# Altium schematic sheet MAZ000176 - Diagrama eléctrico.SchDoc: MAZ000176 - Diagrama eléctrico
size A; ApprovedBy: Christian Ledwidth; CheckedBy: Nahuel Martinez; Author: Santiago Marti; CompanyName: Body Health; DrawnBy: Santiago Marti; Revision: A; SheetNumber: 1; SheetTotal: 2
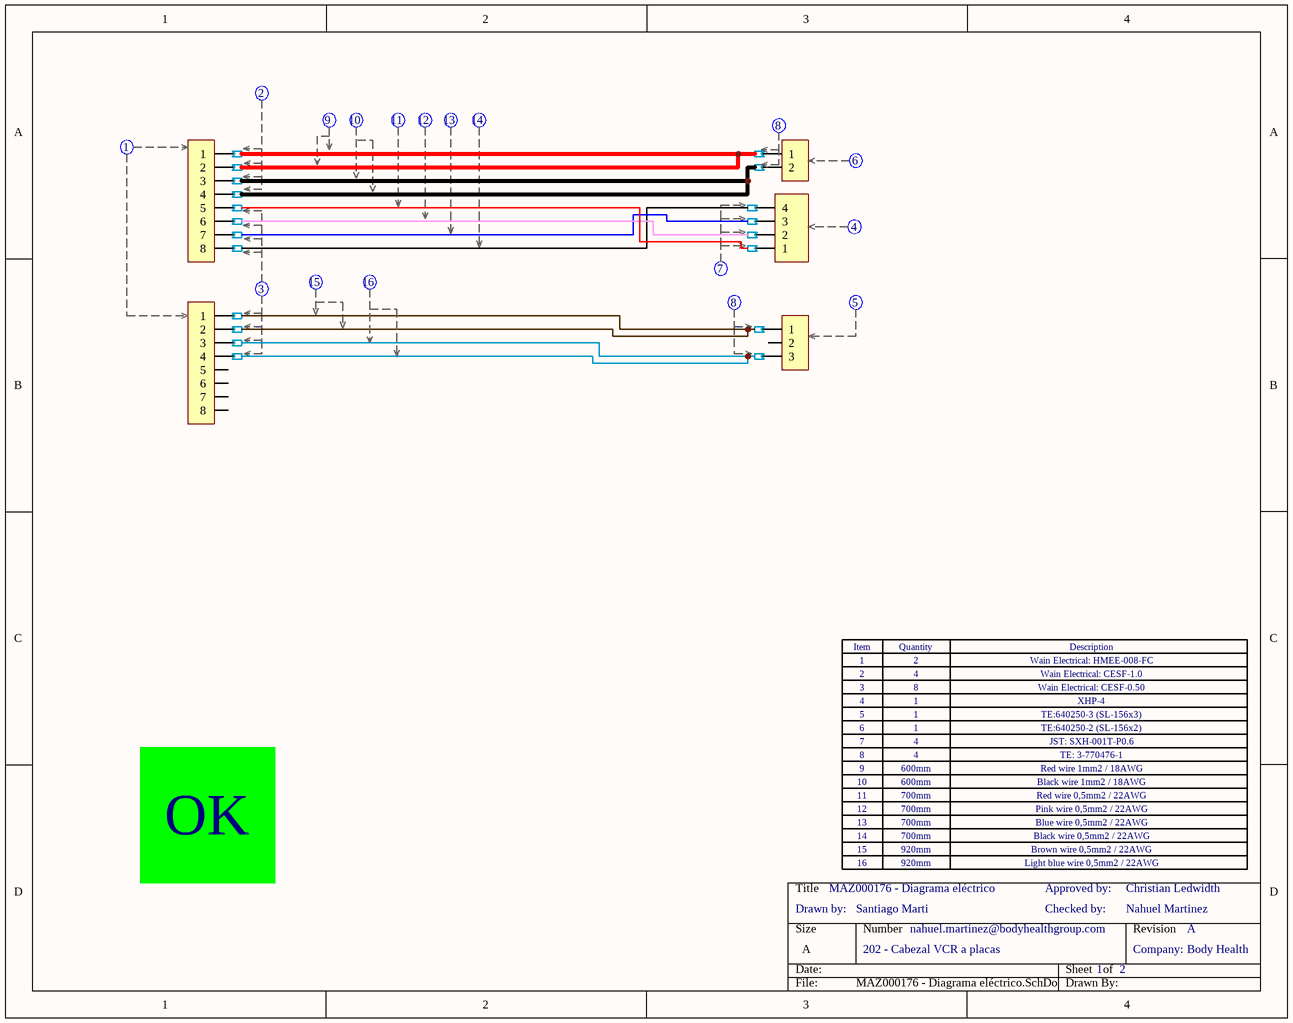
[diagram p0: MAZ000176 - Diagrama eléctrico.SchDoc]

## Parts
(Parts that share a designator on the sheet are numbered #1, #2 ... from top to bottom, then left to right.)
Cab1  Cable  (value not drawn)
Cab2  Cable  (value not drawn)
Cab3  Cable  (value not drawn)
Cab4  Cable  (value not drawn)
Cab5  Cable  (value not drawn)
Cab6  Cable  (value not drawn)
Cab7  Cable  (value not drawn)
Cab?  Cable  (value not drawn)
Con1  SL156-2  (value not drawn)  (parts C,D of 4)
Con2  SL156-3  (value not drawn)  (part C of 4)
Con3  XHP-4  (value not drawn)  (part D of 4)
Con4  09140083101  (value not drawn)  (parts C,D of 4)
Con5  SL156-2  (value not drawn)  (part C of 4)
Con6  09140083101  (value not drawn)  (parts C,D of 4)
Con7  SL156-2  (value not drawn)  (part C of 4)
Con8  SL156-2  (value not drawn)  (part C of 4)
Con?#1  SL156-2  (value not drawn)  (part C of 4)
Con?#2  SL156-3  (value not drawn)  (part C of 4)
Con?#3  SL156-3  (value not drawn)  (part D of 4)
Soc1  sock_XHP_SXH-002T-P0.6  (value not drawn)  (part B of 2)
Soc2  sock_XHP_SXH-002T-P0.6  (value not drawn)  (part B of 2)
Soc3  sock_XHP_SXH-002T-P0.6  (value not drawn)  (part B of 2)
Soc4  sock_XHP_SXH-002T-P0.6  (value not drawn)  (part B of 2)
Soc5  sock_HAR-Female_09330006214  (value not drawn)  (part B of 2)
Soc7  sock_HAR-Female_09330006214  (value not drawn)  (part B of 2)
Soc8  sock_HAR-Female_09330006214  (value not drawn)  (part B of 2)
Soc10  sock_HAR-Female_09330006214  (value not drawn)  (part B of 2)
Soc11  sock_HAR-Female_09330006227  (value not drawn)  (part B of 2)
Soc12  sock_HAR-Female_09330006227  (value not drawn)  (part B of 2)
Soc13  sock_HAR-Female_09330006227  (value not drawn)  (part B of 2)
Soc14  sock_HAR-Female_09330006227  (value not drawn)  (part B of 2)
Soc15  sock_SL156_770476-1  (value not drawn)  (part B of 2)
Soc16  sock_SL156_770476-1  (value not drawn)  (part B of 2)
Soc17  sock_HAR-Female_09330006227  (value not drawn)  (part B of 2)
Soc18  sock_HAR-Female_09330006227  (value not drawn)  (part B of 2)
Soc19  sock_SL156_770476-1  (value not drawn)  (part B of 2)
Soc20  sock_HAR-Female_09330006227  (value not drawn)  (part B of 2)
Soc21  sock_SL156_770476-1  (value not drawn)  (part B of 2)
Soc22  sock_HAR-Female_09330006227  (value not drawn)  (part B of 2)
Zoc1  Zócalo_Header  (value not drawn)
Zoc2  Zócalo_Item  (value not drawn)
Zoc3  Zócalo_Item  (value not drawn)
Zoc4  Zócalo_Item  (value not drawn)
Zoc5  Zócalo_Item  (value not drawn)
Zoc6  Zócalo_Item  (value not drawn)
Zoc7  Zócalo_Item  (value not drawn)
Zoc8  Zócalo_Item  (value not drawn)
Zoc9  Zócalo_Item  (value not drawn)
Zoc10  Zócalo_Item  (value not drawn)
Zoc11#1  Zócalo_Item  (value not drawn)
Zoc11#2  Zócalo_Item  (value not drawn)
Zoc12#1  Zócalo_Item  (value not drawn)
Zoc12#2  Zócalo_Item  (value not drawn)
Zoc13#1  Zócalo_Item  (value not drawn)
Zoc13#2  Zócalo_Item  (value not drawn)
Zoc14  Zócalo_Item  (value not drawn)

## Nets
NetCon1_1: Con1.1 Soc15.0
NetCon1_2: Con1.2 Soc16.0
NetCon3_1: Con3.1 Soc4.0
NetCon3_2: Con3.2 Soc3.0
NetCon3_3: Con3.3 Soc2.0
NetCon3_4: Con3.4 Soc1.0
NetCon4_1: Con4.1 Soc5.0
NetCon4_2: Con4.2 Soc7.0
NetCon4_3: Con4.3 Soc8.0
NetCon4_4: Con4.4 Soc10.0
NetCon4_5: Con4.5 Soc11.0
NetCon4_6: Con4.6 Soc12.0
NetCon4_7: Con4.7 Soc13.0
NetCon4_8: Con4.8 Soc14.0
NetCon6_1: Con6.1 Soc17.0
NetCon6_2: Con6.2 Soc18.0
NetCon6_3: Con6.3 Soc20.0
NetCon6_4: Con6.4 Soc22.0
NetCon?#3_1: Con?#3.1 Soc19.0
NetCon?#3_3: Con?#3.3 Soc21.0
NetSoc1_1: Soc1.1 Soc14.1
NetSoc2_1: Soc2.1 Soc13.1
NetSoc3_1: Soc3.1 Soc12.1
NetSoc4_1: Soc4.1 Soc11.1
NetSoc5_1: Soc5.1 Soc7.1 Soc15.1
NetSoc8_1: Soc8.1 Soc10.1 Soc16.1
NetSoc17_1: Soc17.1 Soc18.1 Soc19.1
NetSoc20_1: Soc20.1 Soc21.1 Soc22.1

Not connected (* = marked no-connect by the designer): Con6 5 6 7 8; Con?#3 2

## Notes on the sheet
- 1
- 2
- 3
- 4
- 8
- Wain Electrical: HMEE-008-FC
- Wain Electrical: CESF-1.0
- Wain Electrical: CESF-0.50
- XHP-4
- 5
- 6
- 7
- 9
- 10
- 600mm
- TE:640250-3 (SL-156x3)
- TE:640250-2 (SL-156x2)
- JST: SXH-001T-P0.6
- TE: 3-770476-1
- Red wire 1mm2 / 18AWG
- Black wire 1mm2 / 18AWG
- OK
- 11
- 12
- 13
- 14
- 700mm
- Red wire 0,5mm2 / 22AWG
- Pink wire 0,5mm2 / 22AWG
- Blue wire 0,5mm2 / 22AWG
- Black wire 0,5mm2 / 22AWG
- Drawn by:
- 15
- 16
- 920mm
- Checked by:
- Approved by:
- Brown wire 0,5mm2 / 22AWG
- Light blue wire 0,5mm2 / 22AWG
- 202 - Cabezal VCR a placas
- nahuel.martinez@bodyhealthgroup.com
- Company:
- (in symbol Zócalo_Header) Item; Quantity; Description

## Library data of the parts
Cab1 = Cable: CallOut: 9; Largo: *mm; Sección: *mm2; Color: *
Cab2 = Cable: CallOut: 10; Largo: *mm; Sección: *mm2; Color: *
Cab3 = Cable: CallOut: 11; Largo: *mm; Sección: *mm2; Color: *
Cab4 = Cable: CallOut: 12; Largo: *mm; Sección: *mm2; Color: *
Cab5 = Cable: CallOut: 13; Largo: *mm; Sección: *mm2; Color: *
Cab6 = Cable: CallOut: 14; Largo: *mm; Sección: *mm2; Color: *
Cab7 = Cable: CallOut: 15; Largo: *mm; Sección: *mm2; Color: *
Cab? = Cable: CallOut: 16; Largo: *mm; Sección: *mm2; Color: *
Con1 = SL156-2: CONN RECEPT 2 POS W/RAMP SL-156; Cod.Fabricante: 640250-2; Fabricante: TE Connectivity AMP Connectors; CallOut: 7; Cod.DigiKey: A19950-ND; ComponentLink1Description: Manufacturer Link; ComponentLink1URL: https://www.te.com/commerce/DocumentDelivery/DDEController?Action=srchrtrv&DocNm=640250&DocType=Customer+Drawing&DocLang=English; DIGIKEYx50: 0.11420; DIGIKEYx100: NO
Con2 = SL156-3: CONN RECEPT 3 POS W/RAMP SL-156; Cod.Fabricante: 640250-3; Fabricante: TE Connectivity AMP Connectors; CallOut: 4; Cod.DigiKey: A19951-ND; ComponentLink1Description: Manufacturer Link; ComponentLink1URL: https://www.te.com/commerce/DocumentDelivery/DDEController?Action=srchrtrv&DocNm=640250&DocType=Customer+Drawing&DocLang=English; DIGIKEYx50: 0.14460; DIGIKEYx100: 0.13430
Con3 = XHP-4: CONN HOUSING 2.5MM 4POS; Fabricante: JST Sales America Inc.; Cod.DigiKey: 455-2267-ND; Cod.Fabricante: XHP-4; ComponentLink1Description: Manufacturer Link; ComponentLink1URL: http://www.jst-mfg.com/product/pdf/eng/eXH.pdf; DIGIKEYx50: 0.06220; CallOut: *; DIGIKEYx100: NO
Con4 = 09140083101: Han E Female 8 way; Fabricante: HARTING; CallOut: 2; Cod.DigiKey: 1195-1527-ND; Cod.Fabricante: 09140083101; ComponentLink1Description: Manufacturer Link; ComponentLink1URL: https://b2b.harting.com/files/download/PRD/PDF_TS/09140083101_100121409DRW009A.pdf; DIGIKEYx50: 7.60000; DIGIKEYx100: 7.40000
Con5 Con?#1 = SL156-2: CONN RECEPT 2 POS W/RAMP SL-156; Cod.Fabricante: 640250-2; Fabricante: TE Connectivity AMP Connectors; CallOut: 8; Cod.DigiKey: A19950-ND; ComponentLink1Description: Manufacturer Link; ComponentLink1URL: https://www.te.com/commerce/DocumentDelivery/DDEController?Action=srchrtrv&DocNm=640250&DocType=Customer+Drawing&DocLang=English; DIGIKEYx50: 0.11420; DIGIKEYx100: NO
Con6 = 09140083101: Han E Female 8 way; Fabricante: HARTING; CallOut: 1; Cod.DigiKey: 1195-1527-ND; Cod.Fabricante: 09140083101; ComponentLink1Description: Manufacturer Link; ComponentLink1URL: https://b2b.harting.com/files/download/PRD/PDF_TS/09140083101_100121409DRW009A.pdf; DIGIKEYx50: 7.60000; DIGIKEYx100: 7.40000
Con7 = SL156-2: CONN RECEPT 2 POS W/RAMP SL-156; Cod.Fabricante: 640250-2; Fabricante: TE Connectivity AMP Connectors; CallOut: 5; Cod.DigiKey: A19950-ND; ComponentLink1Description: Manufacturer Link; ComponentLink1URL: https://www.te.com/commerce/DocumentDelivery/DDEController?Action=srchrtrv&DocNm=640250&DocType=Customer+Drawing&DocLang=English; DIGIKEYx50: 0.11420; DIGIKEYx100: NO
Con8 = SL156-2: CONN RECEPT 2 POS W/RAMP SL-156; Cod.Fabricante: 640250-2; Fabricante: TE Connectivity AMP Connectors; CallOut: 3; Cod.DigiKey: A19950-ND; ComponentLink1Description: Manufacturer Link; ComponentLink1URL: https://www.te.com/commerce/DocumentDelivery/DDEController?Action=srchrtrv&DocNm=640250&DocType=Customer+Drawing&DocLang=English; DIGIKEYx50: 0.11420; DIGIKEYx100: NO
Con?#2 = SL156-3: CONN RECEPT 3 POS W/RAMP SL-156; Cod.Fabricante: 640250-3; Fabricante: TE Connectivity AMP Connectors; CallOut: 6; Cod.DigiKey: A19951-ND; ComponentLink1Description: Manufacturer Link; ComponentLink1URL: https://www.te.com/commerce/DocumentDelivery/DDEController?Action=srchrtrv&DocNm=640250&DocType=Customer+Drawing&DocLang=English; DIGIKEYx50: 0.14460; DIGIKEYx100: 0.13430
Con?#3 = SL156-3: CONN RECEPT 3 POS W/RAMP SL-156; Cod.Fabricante: 640250-3; Fabricante: TE Connectivity AMP Connectors; Cod.DigiKey: A19951-ND; ComponentLink1Description: Manufacturer Link; ComponentLink1URL: https://www.te.com/commerce/DocumentDelivery/DDEController?Action=srchrtrv&DocNm=640250&DocType=Customer+Drawing&DocLang=English; DIGIKEYx50: 0.14460; CallOut: *; DIGIKEYx100: 0.13430
Soc1-Soc4 = sock_XHP_SXH-002T-P0.6: CONN SOCKET 26-30AWG CRIMP TIN; Fabricante: JST Sales America Inc.; Cod.DigiKey: 455-2261-1-ND; Cod.Fabricante: SXH-002T-P0.6; ComponentLink1Description: Manufacturer Link; ComponentLink1URL: http://www.jst-mfg.com/product/pdf/eng/eXH.pdf; DIGIKEYx100: 0.03300; CallOut: *; DIGIKEYx50: 0.03420
Soc5 Soc7 Soc8 Soc10 = sock_HAR-Female_09330006214: CONTACT H.D. CRIMP SOCKET 18AWG; Fabricante: HARTING; Cod.DigiKey: 1195-2022-ND; Cod.Fabricante: 09330006214; ComponentLink1Description: Manufacturer Link; ComponentLink1URL: https://b2b.harting.com/files/download/PRD/PDF_DS/HARTING_DS_09330006214_en_2020-02-04.pdf; DIGIKEYx100: 0.55220; CallOut: *; DIGIKEYx50: 0.57620
Soc11-Soc14 Soc17 Soc18 Soc20 Soc22 = sock_HAR-Female_09330006227: CONTACT H.D. CRIMP SKT 22-26AWG; Fabricante: HARTING; Cod.DigiKey: 1195-2031-ND; Cod.Fabricante: 09330006227; ComponentLink1Description: Manufacturer Link; ComponentLink1URL: https://b2b.harting.com/files/download/PRD/PDF_DS/HARTING_DS_09330006227_en_2020-02-04.pdf; DIGIKEYx100: 1.36500; CallOut: *; DIGIKEYx50: 1.43000
Soc15 Soc16 Soc19 Soc21 = sock_SL156_770476-1: CONN SOCKET 18-24AWG CRIMP TIN; Fabricante: TE Connectivity AMP Connectors; Cod.DigiKey: A19993CT-ND; Cod.Fabricante: 770476-1; ComponentLink1Description: Manufacturer Link; ComponentLink1URL: https://www.te.com/commerce/DocumentDelivery/DDEController?Action=srchrtrv&DocNm=770476&DocType=Customer+Drawing&DocLang=English; DIGIKEYx100: 0.08690; CallOut: *; DIGIKEYx50: 0.08180
Zoc1 = Zócalo_Header: Header para el zócalo de referencias
Zoc2-Zoc10 Zoc11#1 Zoc11#2 Zoc12#1 Zoc12#2 Zoc13#1 Zoc13#2 Zoc14 = Zócalo_Item: Ítem para el zócalo de referencias; Desginator: *; Quantity: *; ItemDescription: *